# Altium schematic sheet ReconProbe.SchDoc (part 1 of 2) (continued)
## Parts (continued)
C124  Capacitance: 1 uF  [FP-CC0805-0_85-MFG]  (hidden comment: CC0805KKX7R7BB105)
C125  Capacitance: 1 uF  [FP-CC0805-0_85-MFG]  (hidden comment: CC0805KKX7R7BB105)
C126  Capacitance: 0.10 μF  [FP-C0402-BB-MFG]  (hidden comment: C0402C104K4RACTU)
C127  Capacitance: 0.10 μF  [FP-C0402-BB-MFG]  (hidden comment: C0402C104K4RACTU)
C128  Capacitance: 10uF  [FP-CC0603-DC-MFG]  (hidden comment: CC0603KRX5R6BB106)
C129  Capacitance: 0.10 μF  [FP-C0402-BB-MFG]  (hidden comment: C0402C104K4RACTU)
C130  Capacitance: 10uF  [FP-CC0603-DC-MFG]  (hidden comment: CC0603KRX5R6BB106)
C131  Capacitance: 0.10 μF  [FP-C0402-BB-MFG]  (hidden comment: C0402C104K4RACTU)
C132  Capacitance: 0.10 μF  [FP-C0402-BB-MFG]  (hidden comment: C0402C104K4RACTU)
C133  Capacitance: 10uF  [FP-CC0603-DC-MFG]  (hidden comment: CC0603KRX5R6BB106)
C134  Capacitance: 0.10 μF  [FP-C0402-BB-MFG]  (hidden comment: C0402C104K4RACTU)
C135  Capacitance: 10uF  [FP-CC0603-DC-MFG]  (hidden comment: CC0603KRX5R6BB106)
C136  Capacitance: 0.10 μF  [FP-C0402-BB-MFG]  (hidden comment: C0402C104K4RACTU)
C137  Capacitance: 0.10 μF  [FP-C0402-BB-MFG]  (hidden comment: C0402C104K4RACTU)
C138  Capacitance: 10uF  [FP-CC0603-DC-MFG]  (hidden comment: CC0603KRX5R6BB106)
C139  Capacitance: 1nF  [FP-GRM155-0_05-IPC_B]  (hidden comment: GRM1555C1H102JA01D)
C140  Capacitance: 1nF  [FP-GRM155-0_05-IPC_B]  (hidden comment: GRM1555C1H102JA01D)
C141  Capacitance: 1uF  [FP-CL21-IPC_C]  (hidden comment: CL21B105KBFNNNG)
C142  Capacitance: 1 uF  [FP-CC0805-0_85-MFG]  (hidden comment: CC0805KKX7R7BB105)
C143  Capacitance: 1uF  [FP-CL21-IPC_C]  (hidden comment: CL21B105KBFNNNG)
C144  Capacitance: 10 nF  [FP-CC0603-DA-MFG]  (hidden comment: CC0603KRX7R9BB103)
C145  Capacitance: 10 nF  [FP-CC0603-DA-MFG]  (hidden comment: CC0603KRX7R9BB103)
C146  Capacitance: 1 uF  [FP-CC0805-0_85-MFG]  (hidden comment: CC0805KKX7R7BB105)
C147  Capacitance: 1 uF  [FP-CC0805-0_85-MFG]  (hidden comment: CC0805KKX7R7BB105)
CN1  SPDT_SLIDESW  [SPDT_SLIDESW]
CR1  ESD5Z3.3T1G  [SOD-523_0P9X1P3_ONS]
CR2  DESD5V0U1BA-7  [SOD323-L_DIO]  (value not drawn)
CR4  DT2042-04TS-7  [SOIC6_TSOT26-DT2042-04TS_DIO]
D1  1N4148W-7-F  [DIOD-SOD123-2_V]  (value not drawn)
D2  1N4148W-7-F  [DIOD-SOD123-2_V]  (value not drawn)
D3  Bright Green, 2V, 20°  [WL-SMRW_1206 dome_normal use]  (value not drawn)
D4  1N4148W-7-F  [DIOD-SOD123-2_V]  (value not drawn)
D5  1N4148W-7-F  [DIOD-SOD123-2_V]  (value not drawn)
D6  1N4148W-7-F  [DIOD-SOD123-2_V]  (value not drawn)
D7  1N4148W-7-F  [DIOD-SOD123-2_V]  (value not drawn)
D8  1N4148W-7-F  [DIOD-SOD123-2_V]  (value not drawn)
D9  1N4148W-7-F  [DIOD-SOD123-2_V]  (value not drawn)
D10  1N4148W-7-F  [DIOD-SOD123-2_V]  (value not drawn)
D11  1N4148W-7-F  [DIOD-SOD123-2_V]  (value not drawn)
D12  1N4148W-7-F  [DIOD-SOD123-2_V]  (value not drawn)
D13  1N4148W-7-F  [DIOD-SOD123-2_V]  (value not drawn)
D14  1N4148W-7-F  [DIOD-SOD123-2_V]  (value not drawn)
D15  1N4148W-7-F  [DIOD-SOD123-2_V]  (value not drawn)
D16  1N4148W-7-F  [DIOD-SOD123-2_V]  (value not drawn)
D17  1N4148W-7-F  [DIOD-SOD123-2_V]  (value not drawn)
D18  1N4148W-7-F  [DIOD-SOD123-2_V]  (value not drawn)
D19  1N4148W-7-F  [DIOD-SOD123-2_V]  (value not drawn)
D20  1N4148W-7-F  [DIOD-SOD123-2_V]  (value not drawn)
D21  1N4148W-7-F  [DIOD-SOD123-2_V]  (value not drawn)
D22  151031VS06000  [WL-TMRC_D3.95H5.3]  (value not drawn)
D23  151031VS06000  [WL-TMRC_D3.95H5.3]  (value not drawn)
D24  1N4148W-7-F  [DIOD-SOD123-2_V]  (value not drawn)
D25  1N4148W-7-F  [DIOD-SOD123-2_V]  (value not drawn)
D26  1N4148W-7-F  [DIOD-SOD123-2_V]  (value not drawn)
D27  LSM115JE3/TR13  [FP-DO-214BA-IPC_C]
D28  151031VS06000  [WL-TMRC_D3.95H5.3]  (value not drawn)
J2  4POS_Header  [4POS_Header]
J7  UJ2-BH-1-TH  [UJ2-BH-1-TH_CUD]
J10  PJ-002B  [CUI_PJ-002B]
J16  M20-9990245  [HARWIN_M20-9990245]  (value not drawn)
J17  M20-9990245  [HARWIN_M20-9990245]  (value not drawn)
K1  DPDT_RELAY  [DPDT_RELAY]
K2  DPDT_RELAY  [DPDT_RELAY]
K3  DPDT_RELAY  [DPDT_RELAY]
K4  SPDT  [J1031C5VDC.15S]
K5  SPDT  [J1031C5VDC.15S]
K6  SPDT  [J1031C5VDC.15S]
K7  SPDT  [J1031C5VDC.15S]
K8  SPDT  [J1031C5VDC.15S]
K9  SPDT  [J1031C5VDC.15S]
K10  SPDT  [J1031C5VDC.15S]
K11  SPDT  [J1031C5VDC.15S]
K12  SPDT  [J1031C5VDC.15S]
K13  SPDT  [J1031C5VDC.15S]
K14  SPDT  [J1031C5VDC.15S]
K15  SPDT  [J1031C5VDC.15S]
K16  SPDT  [J1031C5VDC.15S]
K17  SPDT  [J1031C5VDC.15S]
K18  SPDT  [J1031C5VDC.15S]
K19  SPDT  [J1031C5VDC.15S]
K20  SPDT  [J1031C5VDC.15S]
K21  SPDT  [J1031C5VDC.15S]
K22  DPDT_RELAY  [DPDT_RELAY]
K23  SPDT  [J1031C5VDC.15S]
L1  Inductance: 2.2uH  [FP-DFE252012C-MFG]  (hidden comment: DFE252012P-2R2M=P2)
Q1  2N7002KT1G  [FP-318-08-MFG]  (value not drawn)
Q2  2N7002KT1G  [FP-318-08-MFG]  (value not drawn)
Q3  2N7002KT1G  [FP-318-08-MFG]  (value not drawn)
Q4  2N7002KT1G  [FP-318-08-MFG]  (value not drawn)
Q5  2N7002KT1G  [FP-318-08-MFG]  (value not drawn)
Q6  DMG2305UX-7  [FP-SOT23-MFG]
Q7  DMG2305UX-7  [FP-SOT23-MFG]
Q8  DMG2305UX-7  [FP-SOT23-MFG]  (value not drawn)
Q9  DMG2305UX-7  [FP-SOT23-MFG]  (value not drawn)
Q10  2N7002KT1G  [FP-318-08-MFG]  (value not drawn)
Q11  2N7002KT1G  [FP-318-08-MFG]  (value not drawn)
Q12  2N7002KT1G  [FP-318-08-MFG]  (value not drawn)
Q13  2N7002KT1G  [FP-318-08-MFG]  (value not drawn)
Q14  2N7002KT1G  [FP-318-08-MFG]  (value not drawn)
Q15  2N7002KT1G  [FP-318-08-MFG]  (value not drawn)
Q16  2N7002KT1G  [FP-318-08-MFG]  (value not drawn)
Q17  2N7002KT1G  [FP-318-08-MFG]  (value not drawn)
Q18  2N7002KT1G  [FP-318-08-MFG]  (value not drawn)
Q19  2N7002KT1G  [FP-318-08-MFG]  (value not drawn)
Q20  2N7002KT1G  [FP-318-08-MFG]  (value not drawn)
Q21  2N7002KT1G  [FP-318-08-MFG]  (value not drawn)
Q22  2N7002KT1G  [FP-318-08-MFG]  (value not drawn)
Q23  2N7002KT1G  [FP-318-08-MFG]  (value not drawn)
Q24  2N7002KT1G  [FP-318-08-MFG]  (value not drawn)
Q25  2N7002KT1G  [FP-318-08-MFG]  (value not drawn)
Q26  2N7002KT1G  [FP-318-08-MFG]  (value not drawn)
Q27  DMG2305UX-7  [FP-SOT23-MFG]  (value not drawn)
Q28  2N7002KT1G  [FP-318-08-MFG]  (value not drawn)
Q29  2N7002KT1G  [FP-318-08-MFG]  (value not drawn)
R1  Resistance: 200kR  [FP-RMCF0805-IPC_A]  (hidden comment: RMCF0805FT200K)
R2  Resistance: 200kR  [FP-RMCF0805-IPC_A]  (hidden comment: RMCF0805FT200K)
R3  Resistance: 4.7kR  [FP-CRCW0805-e3-IPC_B]  (hidden comment: CRCW08054K70FKEA)
R4  Resistance: 4.7kR  [FP-CRCW0805-e3-IPC_B]  (hidden comment: CRCW08054K70FKEA)
R5  Resistance: 4.7kR  [FP-CRCW0805-e3-IPC_B]  (hidden comment: CRCW08054K70FKEA)
R6  Resistance: 4.7kR  [FP-CRCW0805-e3-IPC_B]  (hidden comment: CRCW08054K70FKEA)
R7  Resistance: 1KOhm  [RESC2013X60X35ML10T20]  (hidden comment: RC0805FR-071KL)
R8  RC0805FR-07604RL  [RESC2013X60X35LL10T20]  (value not drawn)
R9  Resistance: 1KOhm  [RESC2013X60X35ML10T20]  (hidden comment: RC0805FR-071KL)
R10  Resistance: 10kR  [FP-RMCF0805-MFG]  (hidden comment: RMCF0805FT10K0)
R11  RMCF0603FT100K  [FP-RMCF0603-IPC_C]  (value not drawn)
R12  Resistance: 10kR  [FP-RMCF0805-MFG]  (hidden comment: RMCF0805FT10K0)
R13  Resistance: 10kR  [FP-RMCF0805-MFG]  (hidden comment: RMCF0805FT10K0)
R14  Resistance: 10kR  [FP-RMCF0805-MFG]  (hidden comment: RMCF0805FT10K0)
R15  Resistance: 604  [RESC2013X60X35LL10T20]  (hidden comment: RC0805FR-07604RL)
R16  Resistance: 1KOhm  [RESC2013X60X35ML10T20]  (hidden comment: RC0805FR-071KL)
R17  Resistance: 10kR  [FP-RMCF0805-MFG]  (hidden comment: RMCF0805FT10K0)
R18  Resistance: 1KOhm  [RESC2013X60X35ML10T20]  (hidden comment: RC0805FR-071KL)
R19  Resistance: 10kR  [FP-RMCF0805-MFG]  (hidden comment: RMCF0805FT10K0)
R20  Resistance: 1KOhm  [RESC2013X60X35ML10T20]  (hidden comment: RC0805FR-071KL)
R21  Resistance: 1KOhm  [RESC2013X60X35ML10T20]  (hidden comment: RC0805FR-071KL)
R22  Resistance: 1KOhm  [RESC2013X60X35ML10T20]  (hidden comment: RC0805FR-071KL)
R23  Resistance: 5.1 KR  [RESC2013X60X35ML10T20]  (hidden comment: RC0805JR-075K1L)
R24  Resistance: 1KOhm  [RESC2013X60X35ML10T20]  (hidden comment: RC0805FR-071KL)
R25  ERA6AEB202V  [RESC2013X60X40ML20T25]  (value not drawn)
R26  ERA6AEB202V  [RESC2013X60X40ML20T25]  (value not drawn)
R27  CRCW08054K00FKTA  [RESC2012X50N]
R28  Resistance: 1KOhm  [RESC2013X60X35ML10T20]  (hidden comment: RC0805FR-071KL)
R29  CRCW08054K00FKTA  [RESC2012X50N]
R30  Resistance: 1KOhm  [RESC2013X60X35ML10T20]  (hidden comment: RC0805FR-071KL)
R31  Resistance: 5.1 KR  [RESC2013X60X35ML10T20]  (hidden comment: RC0805JR-075K1L)
R32  Resistance: 10000R  [FP-CRCW0805-Ce3-MFG]  (hidden comment: CRCW080510K0FKEAC)
R33  Resistance: 1KOhm  [RESC2013X60X35ML10T20]  (hidden comment: RC0805FR-071KL)
R34  Resistance: 1KOhm  [RESC2013X60X35ML10T20]  (hidden comment: RC0805FR-071KL)
R35  Resistance: 1KOhm  [RESC2013X60X35ML10T20]  (hidden comment: RC0805FR-071KL)
R36  Resistance: 1KOhm  [RESC2013X60X35ML10T20]  (hidden comment: RC0805FR-071KL)
R37  RT0402FRE07500RL  [FP-RT0402-0_35-MFG]
R38  Resistance: 10kR  [FP-RMCF0805-MFG]  (hidden comment: RMCF0805FT10K0)
R39  Resistance: 10kR  [FP-RMCF0805-MFG]  (hidden comment: RMCF0805FT10K0)
R40  Resistance: 10kR  [FP-RMCF0805-MFG]  (hidden comment: RMCF0805FT10K0)
R41  Resistance: 5.1 KR  [RESC2013X60X35ML10T20]  (hidden comment: RC0805JR-075K1L)
R42  Resistance: 10kR  [FP-RMCF0805-MFG]  (hidden comment: RMCF0805FT10K0)
R43  Resistance: 10kR  [FP-RMCF0805-MFG]  (hidden comment: RMCF0805FT10K0)
R44  Resistance: 10kR  [FP-RMCF0805-MFG]  (hidden comment: RMCF0805FT10K0)
R45  Resistance: 10kR  [FP-RMCF0805-MFG]  (hidden comment: RMCF0805FT10K0)
R46  Resistance: 10kR  [FP-RMCF0805-MFG]  (hidden comment: RMCF0805FT10K0)
R47  Resistance: 10kR  [FP-RMCF0805-MFG]  (hidden comment: RMCF0805FT10K0)
R48  Resistance: 10kR  [FP-RMCF0805-MFG]  (hidden comment: RMCF0805FT10K0)
R49  Resistance: 10kR  [FP-RMCF0805-MFG]  (hidden comment: RMCF0805FT10K0)
R50  Resistance: 10kR  [FP-RMCF0805-MFG]  (hidden comment: RMCF0805FT10K0)
R51  Resistance: 10kR  [FP-RMCF0805-MFG]  (hidden comment: RMCF0805FT10K0)
R52  Resistance: 10kR  [FP-RMCF0805-MFG]  (hidden comment: RMCF0805FT10K0)
R53  Resistance: 10kR  [FP-RMCF0805-MFG]  (hidden comment: RMCF0805FT10K0)
R54  Resistance: 10kR  [FP-RMCF0805-MFG]  (hidden comment: RMCF0805FT10K0)
R55  Resistance: 10kR  [FP-RMCF0805-MFG]  (hidden comment: RMCF0805FT10K0)
R56  Resistance: 10kR  [FP-RMCF0805-MFG]  (hidden comment: RMCF0805FT10K0)
R57  Resistance: 10kR  [FP-RMCF0805-MFG]  (hidden comment: RMCF0805FT10K0)
R58  Resistance: 10kR  [FP-RMCF0805-MFG]  (hidden comment: RMCF0805FT10K0)
R59  Resistance: 10kR  [FP-RMCF0805-MFG]  (hidden comment: RMCF0805FT10K0)
R60  ERA6AEB101V  [RESC2013X60X40ML20T25]  (value not drawn)
R61  ERA6AEB101V  [RESC2013X60X40ML20T25]  (value not drawn)
R62  CRCW08054K00FKTA  [RESC2012X50N]
R63  Resistance: 1KOhm  [RESC2013X60X35ML10T20]  (hidden comment: RC0805FR-071KL)
R64  Resistance: 10kR  [FP-RMCF0805-MFG]  (hidden comment: RMCF0805FT10K0)
R65  Resistance: 10kR  [FP-RMCF0805-MFG]  (hidden comment: RMCF0805FT10K0)
R66  RT0603BRE0750RL  [RESC1608X55N]
R67  Resistance: 1KOhm  [RESC2013X60X35ML10T20]  (hidden comment: RC0805FR-071KL)
R68  ERA6AEB101V  [RESC2013X60X40ML20T25]  (value not drawn)
R69  Resistance: 0 Ohm  [RESC2013X70X40NL20T20]  (hidden comment: ERJ-6GEY0R00V)
R70  Resistance: 0 Ohm  [RESC2013X70X40NL20T20]  (hidden comment: ERJ-6GEY0R00V)
R71  Resistance: 0 Ohm  [RESC2013X70X40NL20T20]  (hidden comment: ERJ-6GEY0R00V)
R72  Resistance: 0 Ohm  [RESC2013X70X40NL20T20]  (hidden comment: ERJ-6GEY0R00V)
R73  Resistance: 10kR  [FP-RMCF0805-MFG]  (hidden comment: RMCF0805FT10K0)
R74  Resistance: 1KOhm  [RESC2013X60X35ML10T20]  (hidden comment: RC0805FR-071KL)
R75  Resistance: 1KOhm  [RESC2013X60X35ML10T20]  (hidden comment: RC0805FR-071KL)
R76  Resistance: 1KOhm  [RESC2013X60X35ML10T20]  (hidden comment: RC0805FR-071KL)
R81  Resistance: 1KOhm  [RESC2013X60X35ML10T20]  (hidden comment: RC0805FR-071KL)
R82  ERA6AEB202V  [RESC2013X60X40ML20T25]  (value not drawn)
S1  L102021ML04Q  [SW_L102021ML04Q]
SW1  SPST Tactile  [TAC_SW_TL6110DF160QP]  (value not drawn)
U1  AXP1T34GWH  [AXP1T34GWH]
U2  AXP1T34GWH  [AXP1T34GWH]
U3  MCP4531-104EMS  [MSOP8_MC_MCH]
U4  MCP4531T-103EMS  [MSOP8_MC_MCH]
U5  NVT2002DP,118  [TSSOP8_SOT505-1_NXP-L]
U6  NVT2002DP,118  [TSSOP8_SOT505-1_NXP-L]
U7  AXP1T34GWH  [AXP1T34GWH]
U8  AD9235BRUZ-40  [RU_28_ADI]
U9  OPA2356AIDR  [D8]
U10  AXP1T34GWH  [AXP1T34GWH]
U11  AXP1T34GWH  [AXP1T34GWH]
U12  AXP1T34GWH  [AXP1T34GWH]
U13  AXP1T34GWH  [AXP1T34GWH]
U14  AXP1T34GWH  [AXP1T34GWH]
U15  SN74LVC1T45DBVR  [DBV0006A_N]
U16  SN74LVC1T45DBVR  [DBV0006A_N]
U17  AXP1T34GWH  [AXP1T34GWH]
U18  AXP1T34GWH  [AXP1T34GWH]
U19  AXP1T34GWH  [AXP1T34GWH]
U20  AXP1T34GWH  [AXP1T34GWH]
U21  SN74LVC1T45DBVR  [DBV0006A_N]
U22  AXP1T34GWH  [AXP1T34GWH]
U23  MCP4531-104EMS  [MSOP8_MC_MCH]
U24  AXP1T34GWH  [AXP1T34GWH]
U25  SN74LVC1T45DBVR  [DBV0006A_N]
U26  AXP1T34GWH  [AXP1T34GWH]
U27  AXP1T34GWH  [AXP1T34GWH]
U28  MCP4531T-103EMS  [MSOP8_MC_MCH]
U29  SN74LVC1T45DBVR  [DBV0006A_N]
U30  OPA2356AIDR  [D8]
U31  AD5245BRJZ100-RL7  [FP-RJ-8-IPC_B]
U32  AXP1T34GWH  [AXP1T34GWH]
U33  AXP1T34GWH  [AXP1T34GWH]
U34  AXP1T34GWH  [AXP1T34GWH]
U35  AXP1T34GWH  [AXP1T34GWH]
U36  SN74LVC1T45DBVR  [DBV0006A_N]
U37  STM32U575ZIT6  [STM32U575ZIT6]  (part A of 3)
U38  AD9235BRUZ-40  [RU_28_ADI]
U39  AD9235BRUZ-40  [RU_28_ADI]
U40  ECMF02-2AMX6  [QFN-6L_STM]
U41  SC4216HSETRT  [SC4216H_SEM]
U42  TPS7A2030PDBVR  [DBV0005A-IPC_A]
U43  TPS7A0225PDBVR  [SOT23_DBV_TEX]
U44  LM2660M  [SOIC127P599X175-8N]
U45  TPS62143RGTR  [QFN50P300X300X100-17N]
U46  TPS72325DBVR  [DBV0005A]
U47  OPA2320AIDR  [SOIC127P599X175-8N]
U48  OPA2320AIDR  [SOIC127P599X175-8N]
U49  OPA2320AIDR  [SOIC127P599X175-8N]
U50  TLV75533PDBVR  [DBV0005A-IPC_A]
U51  AXP1T34GWH  [AXP1T34GWH]
U52  AD5245BRJZ100-RL7  [FP-RJ-8-IPC_B]
U53  OPA320AIDBVR  [SOT95P280X145-5N]
U54  OPA320AIDBVR  [SOT95P280X145-5N]
U55  AXP1T34GWH  [AXP1T34GWH]
U56  AXP1T34GWH  [AXP1T34GWH]
U57  TPS7A0225PDBVR  [SOT23_DBV_TEX]
VUSB  1.10mm hole  [TestPoint_1.10mm]  (value not drawn)
Y1  Frequency: 25MHz  [S5D25.000000A20F30T]  (hidden comment: S5D25.000000A20F30T)
Y2  Frequency: 25MHz  [S5D25.000000A20F30T]  (hidden comment: S5D25.000000A20F30T)
Y3  Frequency: 32.768kHz  [X321532768KID2SI]  (hidden comment: X321532768KID2SI)

## Blocks framed on the sheet
SWITCHING NETWORK: C99-C117 C119 D1 D2 D4-D21 K1 K2 K4-K21 Q1 Q2 Q4 Q5 Q10-Q25 R39 R40 R42-R59 R69-R72
SOURCING: AD1 AD2 C3 C6-C20 C84 C120 C121 C144 C145 D24 K3 Q6-Q9 Q26 Q27 R7-R9 R15 R16 R18 R67 R68 R73 R81 U3 U4 U9 U23 U28 U30 U31 U52 U53 Y1 Y2
LEVEL SHIFT: C1 C2 C4 C5 C122-C125 R1-R6 R10 R12-R14 R17 R19 U1 U2 U5-U7 U10-U22 U24-U27 U29 U32-U36 U51 U55 U56
MICROCONTROLLER: C27 C43 C50 C57-C66 C70 C72-C75 C77-C80 CN1 CR1 CR2 CR4 D3 D22 D23 D28 J2 J7 Q3 R24-R26 R32 R36 R38 R82 SW1 U37 U40 VUSB Y3
MONITORING: C21-C26 C28-C42 C44-C49 C51-C54 C76 C118 C126-C143 C146 C147 D25 D26 K22 K23 Q28 Q29 R20-R23 R27-R31 R33-R35 R37 R41 R60-R66 R74-R76 U8 U38 U39 U47-U49 U54 U57
POWER SUPPLY: 0V5 3V0 3V3 C55 C56 C67-C69 C71 C81-C83 C85-C98 D27 J10 J16 J17 L1 R11 S1 U41-U46 U50

## Ports
BOOT (see ReconProbe[5C]), BOOT (see ReconProbe[5D]), NRST (see ReconProbe[5C]), NRST (see ReconProbe[6C])

## Nets
0V5: 0V5.1 C67.2 C68.1 C69.2 U8.10(VIN-) U38.10(VIN-) U39.10(VIN-) U41.6(VO) U41.7(FB)
2V5: C88.2 U43.5(OUT) U48.8(V+) U49.8(V+) U54.5(V+)
3V0: 3V0.1 C26.1 C29.1 C31.1 C32.1 C33.1 C34.1 C35.1 C37.1 C38.1 C39.1 C44.1 C45.1 C81.2 C93.2 C131.1 C132.1 C133.1 C136.1 C137.1 C138.1 R20.2 R28.2 R74.2 U8.7(AVDD) U8.12(AVDD) U38.7(AVDD) U38.12(AVDD) U39.7(AVDD) U39.12(AVDD) U42.5(OUT)
3V3: 3V3.1 C36.1 C46.1 C49.1 C52.1 C53.1 C54.1 C55.1 C56.2 C57.1 C58.1 C59.1 C60.1 C61.1 C62.1 C63.1 C64.1 C65.1 C66.1 C70.2 C72.1 C73.1 C74.1 C75.1 C77.1 C94.2 C95.1 C96.2 C122.2 C123.2 C135.1 C139.1 C140.1 CN1.1 R10.1 R12.1 R13.1 R14.1 R17.1 R19.1 R24.2 U1.1(VCCI) U2.1(VCCI) U5.2(VREFA) U6.2(VREFA) U7.1(VCCI) U8.24(DRVDD) U10.1(VCCI) U11.1(VCCI) U12.1(VCCI) U13.1(VCCI) U14.1(VCCI) U15.1(VCCA) U16.1(VCCA) U17.1(VCCI) U18.1(VCCI) U19.1(VCCI) U20.1(VCCI) U21.1(VCCA) U22.1(VCCI) U24.1(VCCI) U25.1(VCCA) U26.1(VCCI) U27.1(VCCI) U29.1(VCCA) U32.1(VCCI) U33.1(VCCI) U34.1(VCCI) U35.1(VCCI) U36.1(VCCA) U37.6(VBAT) U37.17(VDD_1) U37.33(VDDA) U37.39(VDD_2) U37.52(VDD_3) U37.62(VDD_4) U37.72(VDD_5) U37.84(VDD_6) U37.95(VDDIO2_1) U37.106(VDDUSB) U37.108(VDD_7) U37.121(VDD_8) U37.131(VDDIO2_2) U37.144(VDD_9) U38.24(DRVDD) U39.24(DRVDD) U41.2(EN) U41.3(VIN) U50.5(OUT) U51.1(VCCI) U55.1(VCCI) U56.1(VCCI)  [also labelled MCU_VBAT, MCU_VDD, MCU_VDDA, MCU_VDDIO2, MCU_VDDUSB]
5V: AD1.2(VDD) AD2.2(VDD) C1.1 C2.1 C3.1 C9.1 C10.1 C11.1 C13.2 C14.1 C18.1 C19.1 C71.2 C84.2 C89.2 C97.2 C98.1 C99.2 C100.2 C101.2 C102.2 C103.2 C104.2 C105.2 C106.2 C107.2 C108.2 C109.2 C110.2 C111.2 C112.2 C113.2 C114.2 C115.2 C116.2 C117.2 C119.2 C124.2 C125.2 C141.2 C143.2 C147.2 D1.2(K) D2.2(K) D4.2(K) D5.2(K) D6.2(K) D7.2(K) D8.2(K) D9.2(K) D10.2(K) D11.2(K) D12.2(K) D13.2(K) D14.2(K) D15.2(K) D16.2(K) D17.2(K) D18.2(K) D19.2(K) D20.2(K) D21.2(K) D24.2(K) D25.2(K) D26.2(K) D27.1(C) K1.8(V+) K2.8(V+) K3.8(V+) K4.5(V+) K5.5(V+) K6.5(V+) K7.5(V+) K8.5(V+) K9.5(V+) K10.5(V+) K11.5(V+) K12.5(V+) K13.5(V+) K14.5(V+) K15.5(V+) K16.5(V+) K17.5(V+) K18.5(V+) K19.5(V+) K20.5(V+) K21.5(V+) K22.8(V+) K23.5(V+) Q6.2(SOURCE) Q7.2(SOURCE) R1.1 R2.1 R3.1 R4.1 R5.1 R6.1 S1.2 U1.5(VCCO) U2.5(VCCO) U3.7(P0B) U3.8(VDD) U4.1(HVC/A0) U4.8(VDD) U7.5(VCCO) U9.8(V+) U10.5(VCCO) U11.5(VCCO) U12.5(VCCO) U13.5(VCCO) U14.5(VCCO) U15.6(VCCB) U16.6(VCCB) U17.5(VCCO) U18.5(VCCO) U19.5(VCCO) U20.5(VCCO) U21.6(VCCB) U22.5(VCCO) U23.1(HVC/A0) U23.7(P0B) U23.8(VDD) U24.5(VCCO) U25.6(VCCB) U26.5(VCCO) U27.5(VCCO) U28.8(VDD) U29.6(VCCB) U30.8(V+) U31.2(VDD) U32.5(VCCO) U33.5(VCCO) U34.5(VCCO) U35.5(VCCO) U36.6(VCCB) U42.1(IN) U42.3(EN) U43.1(IN) U43.3(EN) U44.8(V+) U47.8(V+) U50.1(IN) U50.3(EN) U51.5(VCCO) U52.2(VDD) U52.6(AD0) U52.8(A) U53.5(V+) U55.5(VCCO) U56.5(VCCO) U57.1(IN) U57.3(EN) Y1.1(OE) Y1.4(VDD) Y2.1(OE) Y2.4(VDD)
GND: AD1.4(DGND) AD1.9(AGND) AD2.4(DGND) AD2.9(AGND) C1.2 C2.2 C3.2 C4.1 C5.1 C6.2 C7.2 C9.2 C10.2 C11.2 C12.2 C13.1 C14.2 C15.2 C16.2 C18.2 C19.2 C20.2 C21.2 C25.2 C26.2 C27.2 C28.2 C29.2 C30.2 C31.2 C32.2 C33.2 C34.2 C35.2 C36.2 C37.2 C38.2 C39.2 C42.2 C43.2 C44.2 C45.2 C46.2 C48.2 C49.2 C50.2 C51.2 C52.2 C53.2 C54.2 C55.2 C56.1 C57.2 C58.2 C59.2 C60.2 C61.2 C62.2 C63.2 C64.2 C65.2 C66.2 C67.1 C68.2 C69.1 C70.1 C71.1 C72.2 C73.2 C74.2 C75.2 C76.2 C77.2 C79.2 C81.1 C82.1 C84.1 C85.1 C86.2 C87.2 C88.1 C89.1 C90.2 C91.2 C92.2 C93.1 C94.1 C95.2 C96.1 C97.1 C98.2 C99.1 C100.1 C101.1 C102.1 C103.1 C104.1 C105.1 C106.1 C107.1 C108.1 C109.1 C110.1 C111.1 C112.1 C113.1 C114.1 C115.1 C116.1 C117.1 C118.2 C119.1 C120.2 C121.2 C122.1 C123.1 C124.1 C125.1 C126.2 C128.2 C131.2 C132.2 C133.2 C134.2 C135.2 C136.2 C137.2 C138.2 C139.2 C140.2 C141.1 C143.1 C144.2 C145.2 C146.1 C147.1 CN1.4(GND) CN1.5(GND) CR1.2 CR2.1 CR4.2 D22.2(K) D23.2(K) D28.2(K) J2.2 J7.4(GND) J7.5(SHIELD) J7.6(SHIELD) J10.2 J10.3 J16.1 J16.2 J17.1 J17.2 Q1.2(Source) Q2.2(Source) Q3.2(Source) Q4.2(Source) Q5.2(Source) Q10.2(Source) Q11.2(Source) Q12.2(Source) Q13.2(Source) Q14.2(Source) Q15.2(Source) Q16.2(Source) Q17.2(Source) Q18.2(Source) Q19.2(Source) Q20.2(Source) Q21.2(Source) Q22.2(Source) Q23.2(Source) Q24.2(Source) Q25.2(Source) Q26.2(Source) Q28.2(Source) Q29.2(Source) R8.1 R15.2 R22.1 R23.1 R31.1 R32.2 R33.1 R34.1 R35.1 R38.1 R39.2 R40.2 R41.1 R42.2 R43.2 R44.2 R45.2 R46.1 R47.1 R48.1 R49.1 R50.1 R51.1 R52.1 R53.1 R54.1 R55.1 R56.1 R57.1 R58.1 R59.1 R63.1 R64.2 R65.2 R67.2 R69.1 R70.1 R71.1 R72.1 R73.2 R76.1 R81.1 SW1.2 SW1.3(SH) SW1.4(SH) U1.3(GND) U2.3(GND) U3.1(HVC/A0) U3.4(VSS) U3.5(P0A) U4.4(VSS) U5.1(GND) U6.1(GND) U7.3(GND) U8.8(AGND) U8.11(AGND) U8.23(DGND) U9.4(V-) U10.3(GND) U11.3(GND) U12.3(GND) U13.3(GND) U14.3(GND) U15.2(GND) U16.2(GND) U17.3(GND) U18.3(GND) U19.3(GND) U20.3(GND) U21.2(GND) U22.3(GND) U23.4(VSS) U23.5(P0A) U24.3(GND) U25.2(GND) U26.3(GND) U27.3(GND) U28.1(HVC/A0) U28.4(VSS) U29.2(GND) U30.4(V-) U31.1(W) U31.3(GND) U31.6(AD0) U32.3(GND) U33.3(GND) U34.3(GND) U35.3(GND) U36.2(GND) U37.16(VSS_1) U37.30(VSSA) U37.38(VSS_2) U37.51(VSS_3) U37.61(VSS_4) U37.71(VSS_5) U37.83(VSS_6) U37.94(VSS_7) U37.107(VSS_8) U37.120(VSS_9) U37.130(VSS_10) U37.143(VSS_11) U38.8(AGND) U38.11(AGND) U38.23(DGND) U39.8(AGND) U39.11(AGND) U39.23(DGND) U40.3(GND) U41.8(GND) U41.EPAD(PAD) U42.2(GND) U43.2(GND) U44.3(GND) U44.6(LV) U45.5(FB) U45.6(AGND) U45.7(FSW) U45.8(DEF) U45.15(PGND) U45.16(PGND) U45.17(EPAD) U46.1(GND) U47.4(V-) U49.3(+INA) U49.5(+INB) U50.2(GND) U51.3(GND) U52.3(GND) U53.2(V-) U55.3(GND) U56.3(GND) U57.2(GND) Y1.2(GND) Y2.2(GND)
N2V5: C90.1 U46.5(OUT) U48.4(V-) U49.4(V-) U54.2(V-)
5VBuck: C87.1 L1.1 R11.2 R82.2 S1.3 U45.14(VOS)
AC_IOUT: K3.5(NO2) Q27.3(DRAIN)
ACOUT: K22.5(NO2) U54.1(OUT) U54.4(-IN)
ADC1_D0: U37.141(PE0) U39.15(D0_LSB)
ADC1_D1: U37.142(PE1) U39.16(D1)
ADC1_D2: U37.1(PE2) U39.17(D2)
ADC1_D3: U37.2(PE3) U39.18(D3)
ADC1_D4: U37.3(PE4) U39.19(D4)
ADC1_D5: U37.4(PE5) U39.20(D5)
ADC1_D6: U37.5(PE6) U39.21(D6)
ADC1_D7: U37.58(PE7) U39.22(D7)
ADC1_D8: U37.59(PE8) U39.25(D8)
ADC1_D9: U37.60(PE9) U39.26(D9)
ADC1_D10: U37.63(PE10) U39.27(D10)
ADC1_D11: U37.64(PE11) U39.28(D11_MSB)
ADC1_D13: U37.66(PE13)
ADC1_D14: U37.67(PE14)
ADC1_D15: U37.68(PE15)
ADC1_INPUT: U39.9(VIN+) U48.1(VOUTA) U48.2(-INA)
ADC1_MODE: C28.1 R21.1 R22.2 U39.2(MODE)
ADC1_OTR: U37.65(PE12) U39.1(OTR)
ADC1_PDWN: R31.2 U39.14(PDWN)
ADC1_PRESCALE: R27.2 U47.1(VOUTA) U47.2(-INA)
ADC1_REFB: C22.1 C23.1 C24.1 U39.5(REFB)
ADC1_REFT: C22.2 C23.2 C24.2 C30.1 U39.6(REFT)
ADC1_SCALE: R27.1 R34.2 U48.3(+INA)
ADC1_SENSE: C21.1 C25.1 U39.3(SENSE) U39.4(VREF)
ADC1_VIN+: K5.3(O) K5.4(O) U47.3(+INA)
ADC2_D0: U37.114(PD0) U38.15(D0_LSB)
ADC2_D1: U37.115(PD1) U38.16(D1)
ADC2_D2: U37.116(PD2) U38.17(D2)
ADC2_D3: U37.117(PD3) U38.18(D3)
ADC2_D4: U37.118(PD4) U38.19(D4)
ADC2_D5: U37.119(PD5) U38.20(D5)
ADC2_D6: U37.122(PD6) U38.21(D6)
ADC2_D7: U37.123(PD7) U38.22(D7)
ADC2_D8: U37.77(PD8) U38.25(D8)
ADC2_D9: U37.78(PD9) U38.26(D9)
ADC2_D10: U37.79(PD10) U38.27(D10)
ADC2_D11: U37.80(PD11) U38.28(D11_MSB)
ADC2_D13: U37.82(PD13)
ADC2_D14: U37.85(PD14)
ADC2_D15: U37.86(PD15)
ADC2_INPUT: U38.9(VIN+) U48.6(-INB) U48.7(VOUTB)
ADC2_MODE: C76.1 R30.1 R33.2 U38.2(MODE)
ADC2_OTR: U37.81(PD12) U38.1(OTR)
ADC2_PDWN: R23.2 U38.14(PDWN)
ADC2_PRESCALE: R29.2 U47.6(-INB) U47.7(VOUTB)
ADC2_REFB: C40.1 C41.1 C47.1 U38.5(REFB)
ADC2_REFT: C40.2 C41.2 C47.2 C48.1 U38.6(REFT)
ADC2_SCALE: R29.1 R35.2 U48.5(+INB)
ADC2_SENSE: C42.1 C51.1 U38.3(SENSE) U38.4(VREF)
ADC2_VIN+: K4.3(O) K4.4(O) U47.5(+INB)
ADC3_D0: U8.15(D0_LSB) U37.56(PG0)
ADC3_D1: U8.16(D1) U37.57(PG1)
ADC3_D2: U8.17(D2) U37.87(PG2)
ADC3_D3: U8.18(D3) U37.88(PG3)
ADC3_D4: U8.19(D4) U37.89(PG4)
ADC3_D5: U8.20(D5) U37.90(PG5)
ADC3_D6: U8.21(D6) U37.91(PG6)
ADC3_D7: U8.22(D7) U37.92(PG7)
ADC3_D8: U8.25(D8) U37.93(PG8)
ADC3_D9: U8.26(D9) U37.124(PG9)
ADC3_D10: U8.27(D10) U37.125(PG10)
ADC3_D11: U8.28(D11_MSB) U37.126(PG11)
ADC3_D13: U37.128(PG13)
ADC3_D14: U37.129(PG14)
ADC3_D15: U37.132(PG15)
ADC3_INPUT: K22.7(O2) U8.9(VIN+)
ADC3_MODE: C118.1 R75.1 R76.2 U8.2(MODE)
ADC3_OTR: U8.1(OTR) U37.127(PG12)
ADC3_REFB: C127.1 C129.1 C130.1 U8.5(REFB)
ADC3_REFT: C127.2 C129.2 C130.2 C134.1 U8.6(REFT)
ADC3_SENSE: C126.1 C128.1 U8.3(SENSE) U8.4(VREF)
ADC_CLK: U8.13(CLK) U37.97(PC7) U38.13(CLK) U39.13(CLK)
Barrel VIN: C85.2 J10.1 U45.10(AVIN) U45.11(PVIN) U45.12(PVIN) U45.13(EN)
BOOT: CN1.2(CMN) R32.1 U37.138(PH3_BOOT0) ; port BOOT
CurSense: K9.6(SW) K13.6(SW) K17.6(SW) K21.6(SW) K23.3(O) K23.4(O) U49.2(-INA)
DAC1_CLK: AD1.5(MCLK) C120.1 Y1.3(OUT)
DAC2_CLK: AD2.5(MCLK) C121.1 Y2.3(OUT)
DC_IOUT: K3.6(NC2) Q9.3(DRAIN)
DPDT1O1: K1.2(O1) K5.1(DEF)
DPDT1O2: K1.7(O2) K5.6(SW)
DPDT2O1: K2.2(O1) K4.1(DEF)
DPDT2O2: K2.7(O2) K4.6(SW)
DPDTMOS1: D1.1(A) K1.1(V-) Q1.3(Drain)
DPDTMOS2: D2.1(A) K2.1(V-) Q2.3(Drain)
IINV_IN: K22.3(NC1) R61.1
IINV_OUT: K22.6(NC2) R60.1 U49.7(VOUTB)
IOFFSET: C142.2 K22.4(NO1)
IOUT: K3.7(O2) K8.6(SW) K12.6(SW) K16.6(SW) K20.6(SW)
MCI2C1_SCL: U5.3(A1) U37.136(PB6)
MCI2C1_SDA: U5.4(A2) U37.133(PB3)
MCI2C3_SCL: U6.4(A2) U37.26(PC0)
MCI2C3_SDA: U6.3(A1) U37.27(PC1)
MCU_D_N: U37.103(PA11) U40.2(D-)
MCU_D_P: U37.104(PA12) U40.1(D+)
NRST: C27.1 CR1.1 SW1.1 U37.25(NRST) ; port NRST
OP1INV1: R8.2 U4.5(P0A) U9.2(INA-)
OP1NINV1: C7.1 R9.1 R67.1 U9.3(INA+)
OP1OF: C8.2 U3.6(P0W) U9.5(INB+)
OP1OUT1: C8.1 U4.6(P0W) U9.1(OUTA)
OP2INV1: R15.1 U28.5(P0A) U30.2(INA-)
OP2NINV1: C16.1 R18.1 R81.2 U30.3(INA+)
OP2OF: C17.2 U23.6(P0W) U30.5(INB+)
OP2OUT1: C17.1 U28.6(P0W) U30.1(OUTA)
PROBE1: K1.3(NC1) K2.3(NC1) K9.3(O) K9.4(O)
PROBE2: K1.6(NC2) K2.6(NC2) K13.3(O) K13.4(O)
PROBE3: K1.4(NO1) K2.4(NO1) K17.3(O) K17.4(O)
PROBE4: K1.5(NO2) K2.5(NO2) K21.3(O) K21.4(O)
PROBE_V1: K3.3(NC1) K6.6(SW) K10.6(SW) K14.6(SW) K18.6(SW)
PROBE_V2: K7.6(SW) K11.6(SW) K15.6(SW) K19.6(SW) U30.6(INB-) U30.7(OUTB)
Rel1: D9.1(A) K6.2(V-) Q10.3(Drain)
Rel2: D7.1(A) K7.2(V-) Q11.3(Drain)
Rel3: D8.1(A) K8.2(V-) Q12.3(Drain)
Rel4: D6.1(A) K9.2(V-) Q13.3(Drain)
Rel5: D13.1(A) K10.2(V-) Q14.3(Drain)
Rel6: D11.1(A) K11.2(V-) Q15.3(Drain)
Rel7: D12.1(A) K12.2(V-) Q16.3(Drain)
Rel8: D10.1(A) K13.2(V-) Q17.3(Drain)
Rel9: D17.1(A) K14.2(V-) Q18.3(Drain)
Rel10: D15.1(A) K15.2(V-) Q19.3(Drain)
Rel11: D16.1(A) K16.2(V-) Q20.3(Drain)
Rel12: D14.1(A) K17.2(V-) Q21.3(Drain)
Rel13: D21.1(A) K18.2(V-) Q22.3(Drain)
Rel14: D19.1(A) K19.2(V-) Q23.3(Drain)
Rel15: D20.1(A) K20.2(V-) Q24.3(Drain)
Rel16: D18.1(A) K21.2(V-) Q25.3(Drain)
REL17: D4.1(A) K5.2(V-) Q5.3(Drain)
REL18: D5.1(A) K4.2(V-) Q4.3(Drain)
REL21: D24.1(A) K3.1(V-) Q26.3(Drain)
SL_SPI1_NSS: AD2.8(FSYNC) U15.4(B)
SL_SPI1_SCK: AD2.7(SCLK) U21.4(B)
SL_SPI1_SDA: AD2.6(SDATA) U16.4(B)
SL_SPI2_NSS: AD1.8(FSYNC) U36.4(B)
SL_SPI2_SCK: AD1.7(SCLK) U25.4(B)
SL_SPI2_SDA: AD1.6(SDATA) U29.4(B)
SLI2C1_SCL: R3.2 U3.2(SCL) U4.2(SCL) U5.6(B1)
SLI2C1_SDA: R4.2 U3.3(SDA) U4.3(SDA) U5.5(B2)
SLI2C3_SCL: R6.2 U6.5(B2) U23.2(SCL) U28.2(SCL) U31.4(SCL) U52.4(SCL)
SLI2C3_SDA: R5.2 U6.6(B1) U23.3(SDA) U28.3(SDA) U31.5(SDA) U52.5(SDA)
SNI1: U11.2(A) U37.10(PF0)
SNI2: U12.2(A) U37.11(PF1)
SNI3: U13.2(A) U37.12(PF2)
SNI4: U14.2(A) U37.13(PF3)
SNI5: U17.2(A) U37.14(PF4)
SNI6: U18.2(A) U37.15(PF5)
SNI7: U19.2(A) U37.18(PF6)
SNI8: U20.2(A) U37.19(PF7)
SNI9: U22.2(A) U37.20(PF8)
SNI10: U26.2(A) U37.21(PF9)
SNI11: U27.2(A) U37.22(PF10)
SNI12: U24.2(A) U37.49(PF11)
SNI13: U32.2(A) U37.50(PF12)
SNI14: U33.2(A) U37.53(PF13)
SNI15: U34.2(A) U37.54(PF14)
SNI16: U35.2(A) U37.55(PF15)
SNI17: U7.2(A) U37.45(PC5)
SNI18: U10.2(A) U37.46(PB0)
SNI19: U1.2(A) U37.47(PB1)
SNI20: U2.2(A) U37.48(PB2)
SNI21: U37.29(PC3) U51.2(A)
SNI22: U37.44(PC4) U55.2(A)
SNI23: U37.73(PB12) U56.2(A)
SNO1: Q10.1(Gate) R44.1 U11.4(B)
SNO2: Q11.1(Gate) R45.1 U12.4(B)
SNO3: Q12.1(Gate) R46.2 U13.4(B)
SNO4: Q13.1(Gate) R47.2 U14.4(B)
SNO5: Q14.1(Gate) R48.2 U17.4(B)
SNO6: Q15.1(Gate) R49.2 U18.4(B)
SNO7: Q16.1(Gate) R50.2 U19.4(B)
SNO8: Q17.1(Gate) R51.2 U20.4(B)
SNO9: Q18.1(Gate) R52.2 U22.4(B)
SNO10: Q19.1(Gate) R53.2 U26.4(B)
SNO11: Q20.1(Gate) R54.2 U27.4(B)
SNO12: Q21.1(Gate) R55.2 U24.4(B)
SNO13: Q22.1(Gate) R56.2 U32.4(B)
SNO14: Q23.1(Gate) R57.2 U33.4(B)
SNO15: Q24.1(Gate) R58.2 U34.4(B)
SNO16: Q25.1(Gate) R59.2 U35.4(B)
SNO17: Q5.1(Gate) R43.1 U7.4(B)
SNO18: Q4.1(Gate) R42.1 U10.4(B)
SNO21: Q26.1(Gate) R73.1 U51.4(B)
SNO22: Q29.1(Gate) R64.1 U55.4(B)
SNO23: Q28.1(Gate) R65.1 U56.4(B)
SNODP1: Q1.1(Gate) R39.1 U1.4(B)
SNODP2: Q2.1(Gate) R40.1 U2.4(B)
SPI1_NSS: U15.3(A) U37.40(PA4)
SPI1_SCK: U21.3(A) U37.35(PA1)
SPI1_SDA: U16.3(A) U37.43(PA7)
SPI2_NSS: U36.3(A) U37.140(PB9)
SPI2_SCK: U25.3(A) U37.74(PB13)
SPI2_SDA: U29.3(A) U37.76(PB15)
STLK_5V: CR4.4 D27.2(A) J2.1 R26.2
STLK_SWCLK: CR4.1 J2.4 U37.109(PA14)
STLK_SWDIO: CR4.3 J2.3 U37.105(PA13)
TIMPOUT: K22.2(O1) R37.2 R66.2 U49.1(VOUTA)
USB_D_N: J7.2(D-) U40.5(D-)
USB_D_P: J7.3(D+) U40.6(D+)
USB_VDD: CR2.2 J7.1(VDD) R25.2 S1.1 VUSB.1
USER_LED: R36.2 U37.7(PC13)
VAC_Curr: K3.4(NO1) U53.3(+IN)
VOUT1: K3.2(O1) U9.6(INB-) U9.7(OUTB)
VREFN: C78.1 C80.2 U37.31(VREF-)
VREFP: C78.2 C80.1 U37.32(VREF+)
NetAD1_1: AD1.1(COMP) C144.1
NetAD1_3: AD1.3(CAP/2.5V) C12.1
NetAD1_10: AD1.10(VOUT) R7.2
NetAD2_1: AD2.1(COMP) C145.1
NetAD2_3: AD2.3(CAP/2.5V) C20.1
NetAD2_10: AD2.10(VOUT) R16.2
NetC4_2: C4.2 R1.2 U5.7(VREFB) U5.8(EN)
NetC5_2: C5.2 R2.2 U6.7(VREFB) U6.8(EN)
NetC6_1: C6.1 R7.1 R9.2
NetC15_1: C15.1 R16.1 R18.2
NetC43_1: C43.1 U37.8(PC14-OSC32_IN) Y3.2(OUT/IN)
NetC50_1: C50.1 U37.9(PC14-OSC32_OUT) Y3.1(IN/OUT)
NetC79_1: C79.1 U37.70(VCAP)
NetC82_2: C82.2 C92.1 U44.5(OUT) U46.2(IN) U46.3(EN)
NetC83_1: C83.1 U44.2(CAP+)
NetC83_2: C83.2 U44.4(CAP-)
NetC86_1: C86.1 U45.9(SS/TR)
NetC91_1: C91.1 U46.4(FB)
NetC142_1: C142.1 R62.1 R63.2 U54.3(+IN)
NetC146_2: C146.2 R62.2 U57.5(OUT)
NetD3_1: D3.1(K) Q3.3(Drain)
NetD3_2: D3.2(A) R24.1
NetD22_1: D22.1(A) R26.1
NetD23_1: D23.1(A) R82.1
NetD25_1: D25.1(A) K22.1(V-) Q29.3(Drain)
NetD26_1: D26.1(A) K23.2(V-) Q28.3(Drain)
NetD28_1: D28.1(A) R25.1
NetK6_1: K6.1(DEF) R69.2
NetK6_3: K6.3(O) K6.4(O) K7.1(DEF)
NetK7_3: K7.3(O) K7.4(O) K8.1(DEF)
NetK8_3: K8.3(O) K8.4(O) K9.1(DEF)
NetK10_1: K10.1(DEF) R70.2
NetK10_3: K10.3(O) K10.4(O) K11.1(DEF)
NetK11_3: K11.3(O) K11.4(O) K12.1(DEF)
NetK12_3: K12.3(O) K12.4(O) K13.1(DEF)
NetK14_1: K14.1(DEF) R71.2
NetK14_3: K14.3(O) K14.4(O) K15.1(DEF)
NetK15_3: K15.3(O) K15.4(O) K16.1(DEF)
NetK16_3: K16.3(O) K16.4(O) K17.1(DEF)
NetK18_1: K18.1(DEF) R72.2
NetK18_3: K18.3(O) K18.4(O) K19.1(DEF)
NetK19_3: K19.3(O) K19.4(O) K20.1(DEF)
NetK20_3: K20.3(O) K20.4(O) K21.1(DEF)
NetK23_1: K23.1(DEF) R37.1
NetK23_6: K23.6(SW) R66.1
NetL1_2: L1.2 U45.1(SW) U45.2(SW) U45.3(SW)
NetQ3_1: Q3.1(Gate) R36.1 R38.2
NetQ6_1: Q6.1(GATE) Q6.3(DRAIN) Q7.1(GATE) Q8.2(SOURCE)
NetQ7_3: Q7.3(DRAIN) Q9.2(SOURCE)
NetQ8_1: Q8.1(GATE) Q8.3(DRAIN) Q9.1(GATE) U31.8(A)
NetQ27_1: Q27.1(GATE) R68.2
NetQ27_2: Q27.2(SOURCE) U52.1(W) U53.4(-IN)
NetR10_2: R10.2 U15.5(DIR)
NetR11_1: R11.1 U45.4(PG)
NetR12_2: R12.2 U16.5(DIR)
NetR13_2: R13.2 U21.5(DIR)
NetR14_2: R14.2 U25.5(DIR)
NetR17_2: R17.2 U29.5(DIR)
NetR19_2: R19.2 U36.5(DIR)
NetR20_1: R20.1 R21.2
NetR28_1: R28.1 R30.2
NetR41_2: R41.2 U8.14(PDWN)
NetR60_2: R60.2 R61.2 U49.6(-INB)
NetR68_1: R68.1 U53.1(OUT)
NetR74_1: R74.1 R75.2

Not connected (* = marked no-connect by the designer): CN1 3(2); CR4 5 6; U4 7(P0B); U28 7(P0B); U31 7(B); U37 23(PH0-OSC_IN) 24(PH0-OSC_OUT) 28(PC2) 34(PA0) 36(PA2) 37(PA3) 41(PA5) 42(PA6) 69(PB10) 75(PB14) 96(PC6) 98(PC8) 99(PC9) 100(PA8) 101(PA9) 102(PA10) 110(PA15) 111(PC10) 112(PC11) 113(PC12) 134(PB4) 135(PB5) 137(PB7) 139(PB8); U40 4(NC); U41 1(NC) 4(NC) 5(NC); U42 4(NC); U43 4(NC); U44 1(FC)* 7(OSC)*; U50 4(NC); U52 7(B); U57 4(NC)

## Layout directives
differential pair: MCU_D_N, MCU_D_P, USB_D_N, USB_D_P

## Notes on the sheet
- (near R2) Remove PU from A side if Vb is 1V more
- Resistor divider (100mV)pkpk
- (near C17) Add decoupling caps for op amps
- Capacitor to gnd on COMP pin
- Yellow - High speed priority routing
  Green - High speed I2C lines
  Blue- High speed SPI lines
  Dark Green - Low freq Switch Net. Sig
- (near U37) If at least 1 PG[15:2] I/O is used  VDDIO2 should be max 2.7 for HSLV=0 and max 3.6 for HSLV = 1
  If USB used, VDDUSB needs 3.3V
  VBAT backup domain: min 1.65 and max 3.6V
  If ADC, DAC, COMP, OPAMP, and VREFBUF used VDDA needs 3.3V
- (in symbol STM32U575ZI6T, part A) GPIO (D,E,F,G); GPIO (A,B,C); CLK, RST, BOOT; PWR SIG
- (in symbol TAC_PB_TL6110DF160QP) SHIELD